# EasyEDA Pro project sle_keyboard.eprj, board PCB1
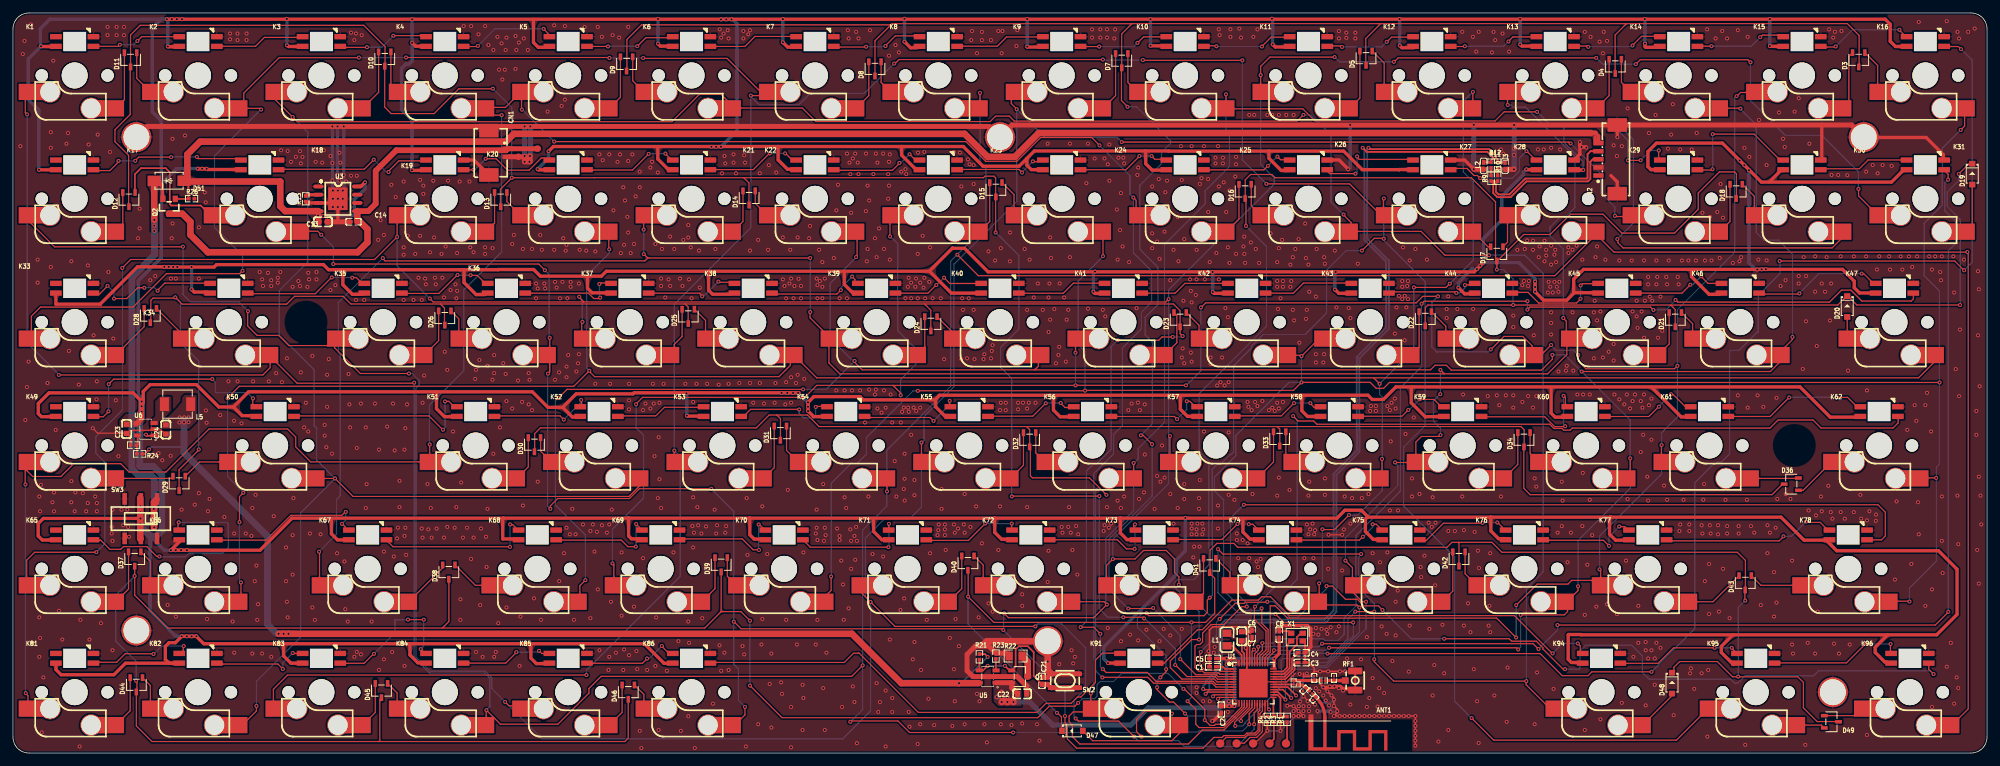
[diagram p2: board, top side]
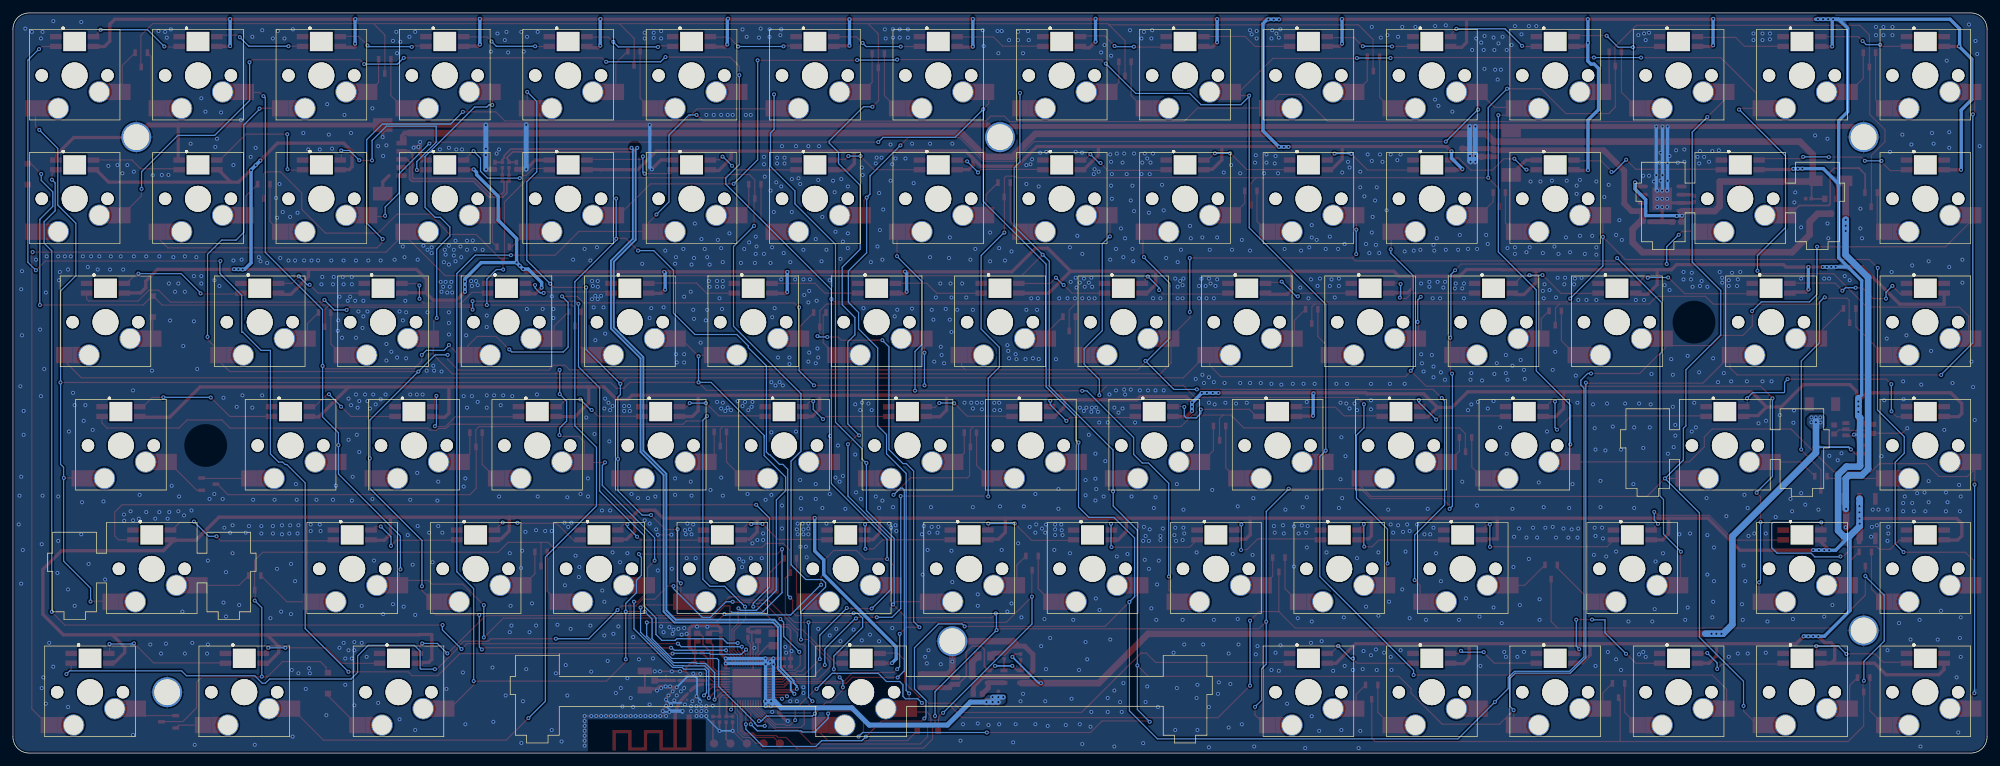
[diagram p3: board, bottom side, seen from below]

Outline 304.8 x 114.3 mm; copper layers: Top Layer, Bottom Layer. Coordinates in mm from the lower left corner of the outline.
Outline path: 0,111.8 0,2.5 0.01,2.3 0.03,2.11 0.07,1.92 0.12,1.73 0.19,1.54 0.27,1.37 0.37,1.19 0.48,1.03 0.6,0.88 0.73,0.73 0.88,0.6 1.03,0.48 1.19,0.37 1.36,0.27 1.54,0.19 1.73,0.12 1.92,0.07 2.11,0.03 2.3,0.01 2.5,0 302.3,0 302.5,0.01 302.69,0.03 302.88,0.07 303.07,0.12 303.26,0.19 303.43,0.27 303.61,0.37 303.77,0.48 303.92,0.6 304.07,0.73 304.2,0.88 304.32,1.03 304.43,1.19 304.53,1.37 304.61,1.54 304.68,1.73 304.73,1.92 304.77,2.11 304.79,2.3 304.8,2.5 304.8,111.8 304.79,112 304.77,112.19 304.73,112.38 304.68,112.57 304.61,112.76 304.53,112.94 304.43,113.11 304.32,113.27 304.2,113.42 304.07,113.57 303.92,113.7 303.77,113.82 303.61,113.93 303.43,114.03 303.26,114.11 303.07,114.18 302.88,114.23 302.69,114.27 302.5,114.29 302.3,114.3 2.5,114.3 2.3,114.29 2.11,114.27 1.92,114.23 1.73,114.18 1.54,114.11 1.36,114.03 1.19,113.93 1.03,113.82 0.88,113.7 0.73,113.57 0.6,113.42 0.48,113.27 0.37,113.11 0.27,112.94 0.19,112.76 0.12,112.57 0.07,112.38 0.03,112.19 0.01,112 0,111.8
Stack: Top Layer 0.035mm / Dielectric1 1.51mm FR4 er 4.5 / Bottom Layer 0.035mm

## Design rules (mm)
net SLE_USB_P: DP1
net SLE_USB_N: DP1
net USB_P: DP2
net USB_N: DP2
template: 自定义配置
spacing copperThickness1oz (default): track to track 0.102, other pairs 0 to 0.3
spacing copperThickness2oz: track to track 0.203, other pairs 0.152 to 0.3
track width copperThickness1oz (default): min 0.127, default 0.254, max 2.54
track width copperThickness2oz: min 0.203, default 0.254, max 2.54
differential pair differentialPair (default): width min 0.127, default 0.254, max 2.54; gap min 0.152, default 0.152
via viaSize (default): diameter min 0.5, default 0.61, max 10; hole min 0.3, default 0.305, max 6.3
['net', 'gnd'] ['NET', 'SLE_3V3'] uses copperThickness1oz

## Placement (name value [footprint] x y rotation side)
ANT1  2.4G板载天线  [ANT-2.4G]  210.69 5.46 180 top
C1  1uF  [C0402]  185.29 13.34 0 top
C2  100nF  [C0402]  186.57 6.73 270 top
C3  2.2uF  [C0402]  198.96 13.97 0 top
C4  1uF  [C0402]  198.96 15.49 0 top
C5  1uF  [C0402]  185.29 14.61 180 top
C6  2.2uF  [C0402]  191.32 18.43 90 top
C7  10uF  [C0603]  189.74 18.03 90 top
C8  4.7uF  [C0402]  195.51 18.29 90 top
C9  NC  [C0201]  200.91 11.61 270 top
C10  NC  [C0201]  203.97 11.61 270 top
C11  NC  [C0201]  200.91 8.38 45 top
C12  NC  [C0201]  199.39 9.78 45 top
C13  10uF  [C0603]  47.88 82.04 0 top
C14  100nF  [C0402]  52.58 82.04 180 top
C21  10nF  [C0402]  158.88 11.16 270 top
C22  10uF  [C0603]  155.83 9.14 0 top
C23  4.7uF  [C0603]  17.56 50.07 90 top
C24  10uF  [C0603]  23.61 49.97 90 top
CN1  1.25-2A-WT  [CONN-TH_1.25-2A-WT]  74.93 92.71 270 top
CN2  1.25-5A-WT  [CONN-SMD_1.25-6A-WT]  246.25 91.69 90 top
D3  BAV70  [SOT-23-3_L3.0-W1.7-P0.95-LS2.9-BR]  284.99 107.06 90 top
D4  BAV70  [SOT-23-3_L3.0-W1.7-P0.95-LS2.9-BR]  247.4 106.05 90 top
D5  BAV70  [SOT-23-3_L3.0-W1.7-P0.95-LS2.9-BR]  208.91 107.32 90 top
D7  BAV70  [SOT-23-3_L3.0-W1.7-P0.95-LS2.9-BR]  171.2 106.93 90 top
D8  BAV70  [SOT-23-3_L3.0-W1.7-P0.95-LS2.9-BR]  133.1 105.66 90 top
D9  BAV70  [SOT-23-3_L3.0-W1.7-P0.95-LS2.9-BR]  94.74 106.43 90 top
D10  BAV70  [SOT-23-3_L3.0-W1.7-P0.95-LS2.9-BR]  57.4 107.19 90 top
D11  BAV70  [SOT-23-3_L3.0-W1.7-P0.95-LS2.9-BR]  18.16 107.06 90 top
D12  BAV70  [SOT-23-3_L3.0-W1.7-P0.95-LS2.9-BR]  17.91 85.47 90 top
D13  BAV70  [SOT-23-3_L3.0-W1.7-P0.95-LS2.9-BR]  75.31 85.47 90 top
D14  BAV70  [SOT-23-3_L3.0-W1.7-P0.95-LS2.9-BR]  113.67 85.73 90 top
D15  BAV70  [SOT-23-3_L3.0-W1.7-P0.95-LS2.9-BR]  151.77 87 90 top
D16  BAV70  [SOT-23-3_L3.0-W1.7-P0.95-LS2.9-BR]  190.25 86.74 90 top
D17  BAV70  [SOT-23-3_L3.0-W1.7-P0.95-LS2.9-BR]  229.11 77.09 90 top
D18  BAV70  [SOT-23-3_L3.0-W1.7-P0.95-LS2.9-BR]  266.06 86.74 90 top
D19  1N4148W  [SOD-123_L2.7-W1.6-LS3.7-FD]  302.51 89.41 90 top
D20  1N4148W  [SOD-123_L2.7-W1.6-LS3.7-FD]  283.21 68.96 90 top
D21  BAV70  [SOT-23-3_L3.0-W1.7-P0.95-LS2.9-BR]  256.67 66.93 90 top
D22  BAV70  [SOT-23-3_L3.0-W1.7-P0.95-LS2.9-BR]  218.06 67.06 90 top
D23  BAV70  [SOT-23-3_L3.0-W1.7-P0.95-LS2.9-BR]  180.21 66.93 90 top
D24  BAV70  [SOT-23-3_L3.0-W1.7-P0.95-LS2.9-BR]  141.73 66.29 90 top
D25  BAV70  [SOT-23-3_L3.0-W1.7-P0.95-LS2.9-BR]  104.27 67.44 90 top
D26  BAV70  [SOT-23-3_L3.0-W1.7-P0.95-LS2.9-BR]  66.68 67.18 90 top
D28  BAV70  [SOT-23-3_L3.0-W1.7-P0.95-LS2.9-BR]  21.21 67.56 90 top
D29  BAV70  [SOT-23-3_L3.0-W1.7-P0.95-LS2.9-BR]  25.65 41.66 90 top
D30  BAV70  [SOT-23-3_L3.0-W1.7-P0.95-LS2.9-BR]  80.52 47.63 90 top
D31  BAV70  [SOT-23-3_L3.0-W1.7-P0.95-LS2.9-BR]  118.49 49.4 90 top
D32  BAV70  [SOT-23-3_L3.0-W1.7-P0.95-LS2.9-BR]  156.97 48.39 90 top
D33  BAV70  [SOT-23-3_L3.0-W1.7-P0.95-LS2.9-BR]  195.58 48.51 90 top
D34  BAV70  [SOT-23-3_L3.0-W1.7-P0.95-LS2.9-BR]  233.3 48.39 90 top
D36  BAV70  [SOT-23-3_L3.0-W1.7-P0.95-LS2.9-BR]  274.57 41.53 0 top
D37  BAV70  [SOT-23-3_L3.0-W1.7-P0.95-LS2.9-BR]  18.8 29.97 90 top
D38  BAV70  [SOT-23-3_L3.0-W1.7-P0.95-LS2.9-BR]  67.3 27.95 90 top
D39  BAV70  [SOT-23-3_L3.0-W1.7-P0.95-LS2.9-BR]  109.35 29.08 90 top
D40  BAV70  [SOT-23-3_L3.0-W1.7-P0.95-LS2.9-BR]  147.45 29.34 90 top
D41  BAV70  [SOT-23-3_L3.0-W1.7-P0.95-LS2.9-BR]  184.77 28.97 90 top
D42  BAV70  [SOT-23-3_L3.0-W1.7-P0.95-LS2.9-BR]  223.27 29.97 90 top
D43  BAV70  [SOT-23-3_L3.0-W1.7-P0.95-LS2.9-BR]  267.46 26.29 90 top
D44  BAV70  [SOT-23-3_L3.0-W1.7-P0.95-LS2.9-BR]  19.05 10.54 90 top
D45  BAV70  [SOT-23-3_L3.0-W1.7-P0.95-LS2.9-BR]  56.9 9.65 90 top
D46  BAV70  [SOT-23-3_L3.0-W1.7-P0.95-LS2.9-BR]  95.01 9.41 90 top
D47  1N4148W  [SOD-123_L2.7-W1.6-LS3.7-FD]  163.58 3.43 180 top
D48  1N4148W  [SOD-123_L2.7-W1.6-LS3.7-FD]  256.16 10.8 90 top
D49  BAV70  [SOT-23-3_L3.0-W1.7-P0.95-LS2.9-BR]  280.77 4.83 180 top
D51  SS54  [SMA_L4.3-W2.6-LS5.0-FD]  24.12 88.38 180 top
K1  DEL  [PCBCOMPONENT_2 - DUPLICATE - DUPLICATE]  9.53 104.65 0 top
K2  F11  [PCBCOMPONENT_2 - DUPLICATE - DUPLICATE]  28.58 104.65 0 top
K3  F11  [PCBCOMPONENT_2 - DUPLICATE - DUPLICATE]  47.63 104.65 0 top
K4  F11  [PCBCOMPONENT_2 - DUPLICATE - DUPLICATE]  66.68 104.65 0 top
K5  F11  [PCBCOMPONENT_2 - DUPLICATE - DUPLICATE]  85.73 104.65 0 top
K6  F11  [PCBCOMPONENT_2 - DUPLICATE - DUPLICATE]  104.78 104.65 0 top
K7  F11  [PCBCOMPONENT_2 - DUPLICATE - DUPLICATE]  123.83 104.65 0 top
K8  F11  [PCBCOMPONENT_2 - DUPLICATE - DUPLICATE]  142.88 104.65 0 top
K9  F11  [PCBCOMPONENT_2 - DUPLICATE - DUPLICATE]  161.93 104.65 0 top
K10  F11  [PCBCOMPONENT_2 - DUPLICATE - DUPLICATE]  180.98 104.65 0 top
K11  F11  [PCBCOMPONENT_2 - DUPLICATE - DUPLICATE]  200.03 104.65 0 top
K12  F11  [PCBCOMPONENT_2 - DUPLICATE - DUPLICATE]  219.08 104.65 0 top
K13  F11  [PCBCOMPONENT_2 - DUPLICATE - DUPLICATE]  238.13 104.65 0 top
K14  F2  [PCBCOMPONENT_2 - DUPLICATE - DUPLICATE]  257.18 104.65 0 top
K15  F1  [PCBCOMPONENT_2 - DUPLICATE - DUPLICATE]  276.23 104.65 0 top
K16  ESC  [PCBCOMPONENT_2 - DUPLICATE - DUPLICATE]  295.28 104.65 0 top
K17  ESC  [PCBCOMPONENT_2 - DUPLICATE - DUPLICATE]  9.53 85.6 0 top
K18  F11  [PCBCOMPONENT_2 - DUPLICATE - DUPLICATE]  38.1 85.6 0 top
K19  F11  [PCBCOMPONENT_2 - DUPLICATE - DUPLICATE]  66.68 85.6 0 top
K20  F11  [PCBCOMPONENT_2 - DUPLICATE - DUPLICATE]  85.73 85.6 0 top
K21  F11  [PCBCOMPONENT_2 - DUPLICATE - DUPLICATE]  104.78 85.6 0 top
K22  F11  [PCBCOMPONENT_2 - DUPLICATE - DUPLICATE]  123.83 85.6 0 top
K23  F11  [PCBCOMPONENT_2 - DUPLICATE - DUPLICATE]  142.88 85.6 0 top
K24  F11  [PCBCOMPONENT_2 - DUPLICATE - DUPLICATE]  161.93 85.6 0 top
K25  F11  [PCBCOMPONENT_2 - DUPLICATE - DUPLICATE]  180.98 85.6 0 top
K26  F11  [PCBCOMPONENT_2 - DUPLICATE - DUPLICATE]  200.03 85.6 0 top
K27  F11  [PCBCOMPONENT_2 - DUPLICATE - DUPLICATE]  219.08 85.6 0 top
K28  F11  [PCBCOMPONENT_2 - DUPLICATE - DUPLICATE]  238.13 85.6 0 top
K29  F11  [PCBCOMPONENT_2 - DUPLICATE - DUPLICATE]  257.18 85.6 0 top
K30  F11  [PCBCOMPONENT_2 - DUPLICATE - DUPLICATE]  276.23 85.6 0 top
K31  F11  [PCBCOMPONENT_2 - DUPLICATE - DUPLICATE]  295.28 85.6 0 top
K33  ESC  [PCBCOMPONENT_2 - DUPLICATE - DUPLICATE]  9.53 66.55 0 top
K34  F11  [PCBCOMPONENT_2 - DUPLICATE - DUPLICATE]  33.34 66.55 0 top
K35  F11  [PCBCOMPONENT_2 - DUPLICATE - DUPLICATE]  57.15 66.55 0 top
K36  F11  [PCBCOMPONENT_2 - DUPLICATE - DUPLICATE]  76.2 66.55 0 top
K37  F11  [PCBCOMPONENT_2 - DUPLICATE - DUPLICATE]  95.25 66.55 0 top
K38  F11  [PCBCOMPONENT_2 - DUPLICATE - DUPLICATE]  114.3 66.55 0 top
K39  F11  [PCBCOMPONENT_2 - DUPLICATE - DUPLICATE]  133.35 66.55 0 top
K40  F11  [PCBCOMPONENT_2 - DUPLICATE - DUPLICATE]  152.4 66.55 0 top
K41  F11  [PCBCOMPONENT_2 - DUPLICATE - DUPLICATE]  171.45 66.55 0 top
K42  F11  [PCBCOMPONENT_2 - DUPLICATE - DUPLICATE]  190.5 66.55 0 top
K43  F11  [PCBCOMPONENT_2 - DUPLICATE - DUPLICATE]  209.55 66.55 0 top
K44  F11  [PCBCOMPONENT_2 - DUPLICATE - DUPLICATE]  228.6 66.55 0 top
K45  F11  [PCBCOMPONENT_2 - DUPLICATE - DUPLICATE]  247.65 66.55 0 top
K46  F11  [PCBCOMPONENT_2 - DUPLICATE - DUPLICATE]  266.7 66.55 0 top
K47  F11  [PCBCOMPONENT_2 - DUPLICATE - DUPLICATE]  290.51 66.55 0 top
K49  ESC  [PCBCOMPONENT_2 - DUPLICATE - DUPLICATE]  9.53 47.5 0 top
K50  F11  [PCBCOMPONENT_2 - DUPLICATE - DUPLICATE]  40.48 47.5 0 top
K51  F11  [PCBCOMPONENT_2 - DUPLICATE - DUPLICATE]  71.44 47.5 0 top
K52  F11  [PCBCOMPONENT_2 - DUPLICATE - DUPLICATE]  90.49 47.5 0 top
K53  F11  [PCBCOMPONENT_2 - DUPLICATE - DUPLICATE]  109.54 47.5 0 top
K54  F11  [PCBCOMPONENT_2 - DUPLICATE - DUPLICATE]  128.59 47.5 0 top
K55  F11  [PCBCOMPONENT_2 - DUPLICATE - DUPLICATE]  147.64 47.5 0 top
K56  F11  [PCBCOMPONENT_2 - DUPLICATE - DUPLICATE]  166.69 47.5 0 top
K57  F11  [PCBCOMPONENT_2 - DUPLICATE - DUPLICATE]  185.74 47.5 0 top
K58  F11  [PCBCOMPONENT_2 - DUPLICATE - DUPLICATE]  204.79 47.5 0 top
K59  F11  [PCBCOMPONENT_2 - DUPLICATE - DUPLICATE]  223.84 47.5 0 top
K60  F11  [PCBCOMPONENT_2 - DUPLICATE - DUPLICATE]  242.89 47.5 0 top
K61  F11  [PCBCOMPONENT_2 - DUPLICATE - DUPLICATE]  261.94 47.5 0 top
K62  F11  [PCBCOMPONENT_2 - DUPLICATE - DUPLICATE]  288.13 47.5 0 top
K65  ESC  [PCBCOMPONENT_2 - DUPLICATE - DUPLICATE]  9.53 28.45 0 top
K66  F11  [PCBCOMPONENT_2 - DUPLICATE - DUPLICATE]  28.58 28.45 0 top
K67  F11  [PCBCOMPONENT_2 - DUPLICATE - DUPLICATE]  54.77 28.45 0 top
K68  F11  [PCBCOMPONENT_2 - DUPLICATE - DUPLICATE]  80.97 28.45 0 top
K69  F11  [PCBCOMPONENT_2 - DUPLICATE - DUPLICATE]  100.02 28.45 0 top
K70  F11  [PCBCOMPONENT_2 - DUPLICATE - DUPLICATE]  119.07 28.45 0 top
K71  F11  [PCBCOMPONENT_2 - DUPLICATE - DUPLICATE]  138.12 28.45 0 top
K72  F11  [PCBCOMPONENT_2 - DUPLICATE - DUPLICATE]  157.17 28.45 0 top
K73  F11  [PCBCOMPONENT_2 - DUPLICATE - DUPLICATE]  176.22 28.45 0 top
K74  F11  [PCBCOMPONENT_2 - DUPLICATE - DUPLICATE]  195.27 28.45 0 top
K75  F11  [PCBCOMPONENT_2 - DUPLICATE - DUPLICATE]  214.32 28.45 0 top
K76  F11  [PCBCOMPONENT_2 - DUPLICATE - DUPLICATE]  233.37 28.45 0 top
K77  F11  [PCBCOMPONENT_2 - DUPLICATE - DUPLICATE]  252.42 28.45 0 top
K78  F11  [PCBCOMPONENT_2 - DUPLICATE - DUPLICATE]  283.37 28.45 0 top
K81  ESC  [PCBCOMPONENT_2 - DUPLICATE - DUPLICATE]  9.53 9.4 0 top
K82  F11  [PCBCOMPONENT_2 - DUPLICATE - DUPLICATE]  28.58 9.4 0 top
K83  F11  [PCBCOMPONENT_2 - DUPLICATE - DUPLICATE]  47.63 9.4 0 top
K84  F11  [PCBCOMPONENT_2 - DUPLICATE - DUPLICATE]  66.68 9.4 0 top
K85  F11  [PCBCOMPONENT_2 - DUPLICATE - DUPLICATE]  85.73 9.4 0 top
K86  F11  [PCBCOMPONENT_2 - DUPLICATE - DUPLICATE]  104.78 9.4 0 top
K91  F11  [PCBCOMPONENT_2 - DUPLICATE - DUPLICATE]  173.84 9.4 0 top
K94  F11  [PCBCOMPONENT_2 - DUPLICATE - DUPLICATE]  245.27 9.4 0 top
K95  F11  [PCBCOMPONENT_2 - DUPLICATE - DUPLICATE]  269.08 9.4 0 top
K96  F11  [PCBCOMPONENT_2 - DUPLICATE - DUPLICATE]  292.9 9.4 0 top
L1  10uH  [L0805]  187.45 17.54 90 top
L2  10uH  [L0402]  227.08 90.69 270 top
L3  10uH  [L0402]  230.38 90.69 90 top
L5  2.2uH  [IND-SMD_L4.4-W4.2]  25.41 53.88 180 top
NOREF  -  [Pad_e235]  186.39 1.48 0 top
NOREF#2  -  [Pad_e136]  152.4 95.12 0 top
NOREF#3  -  [Pad_e232]  194.01 1.48 0 top
NOREF#4  -  [Pad_e3429]  78.04 92.09 0 top
NOREF#5  -  [Pad_e135]  285.75 95.12 0 top
NOREF#6  -  [Pad_e939]  152.65 9.53 0 top
NOREF#7  -  [Pad_e139]  19.05 18.92 0 top
NOREF#8  -  [Pad_e228]  196.55 1.48 0 top
NOREF#9  -  [Pad_e234]  188.93 1.48 0 top
NOREF#10  -  [Pad_e133]  280.99 9.4 0 top
NOREF#11  -  [Pad_e137]  159.77 17.27 0 top
NOREF#12  -  [Pad_e233]  191.47 1.48 0 top
NOREF#13  -  [Pad_e3392]  81.03 93.35 0 top
NOREF#14  -  [Pad_e138]  19.05 95.12 0 top
Q1  CJ3401  [SOT-23-3_L2.9-W1.6-P1.90-LS2.8-BR]  155.45 11.81 180 top
Q2  AO3401A  [SOT-23_L2.9-W1.3-P1.90-LS2.4-BR]  24.11 84.44 90 top
R1  100R  [R0402]  196.72 5.21 270 top
R2  100R  [R0402]  194.69 5.21 270 top
R3  100K  [R0402]  195.71 5.21 90 top
R4  100K  [R0402]  193.68 5.21 270 top
R5  0  [R0201]  197.74 10.84 90 top
R6  0  [R0201#2]  198.12 10.59 180 top
R7  50R  [R0201]  202.34 11.2 0 top
R8  50R  [R0201]  200.41 9.4 135 top
R9  10K  [R0402]  228.22 88.77 90 top
R10  10K  [R0402]  229.24 88.77 90 top
R11  10K  [R0402]  228.22 90.81 90 top
R12  10K  [R0402]  229.24 90.81 90 top
R13  4K  [R0402]  45.21 85.6 90 top
R21  1K  [R0402]  149.22 14.86 90 top
R22  22R  [R0805]  154.81 14.99 0 top
R23  5.1K  [R0402]  151.77 14.99 270 top
R24  90.9K  [R0402]  19.56 46.2 180 top
R25  20K  [R0402]  18.63 47.55 180 top
R26  1M  [R0402]  27.58 85.62 0 top
RF1  BWIPX-1-001E  [IPEX-SMD_BWIPX-1-001E]  206.48 11.2 0 top
SW2  SKRPABE010  [KEY-SMD_4P-L4.2-W3.2-P2.20-LS4.6]  162.43 11.16 180 top
SW3  SS-3235S-L1  [SW-SMD_SS-3235S-LX]  19.75 36.2 0 top
U1  -  [QFN-48_L6.0-W6.0-P0.40-TL-EP4.4]  191.52 10.8 0 top
U3  TP4056X-42-ESOP8  [SOP-8_L4.9-W3.9-P1.27-LS6.0-TL-EP]  50.16 85.6 0 top
U5  MT9700  [SOT-23-5_L3.0-W1.7-P0.95-LS2.8-BR]  150.5 11.81 0 top
U6  TLV62569DBVR  [SOT-23-5_L3.0-W1.7-P0.95-LS2.8-BR]  20.5 50.02 0 top
X1  32MHz  [OSC-SMD_4P-L2.0-W1.6-BL]  198.24 17.9 180 top

## Footprints (pads in the part's own frame, mm; a bottom-side part is the same pattern mirrored in y, then rotated)
ANT-2.4G
  rect 0.508x0.508 smd: 1(8.128,0)
  rect 0.762x0.762 smd: 2(10.287,-0.127)
C0201
  rect 0.368x0.324 smd: 1(-0.275,0) 2(0.275,0)
C0402
  rect 0.79x0.54 smd: 1(-0.545,0) 2(0.545,0)
C0603
  rect 0.8x0.9 smd: 1(-0.7,0) 2(0.7,0)
CONN-SMD_1.25-6A-WT
  rect 0.7x1.6 smd: 1(-2.5,1.45) 2(-1.25,1.45) 3(0,1.45) 4(1.25,1.45) 5(2.5,1.45)
  rect 2.1x3 smd: 6(5.3,-1.45) 7(-5.3,-1.45)
CONN-TH_1.25-2A-WT
  rect 0.7x1.6 smd: 1(-0.625,1.45) 2(0.625,1.45)
  rect 2.1x3 smd: 3(3.425,-1.45) 4(-3.425,-1.45)
IND-SMD_L4.4-W4.2
  rect 1.4x2.12 smd: 1(2.028,0) 2(-2.028,0)
IPEX-SMD_BWIPX-1-001E
  rect 1.05x1 smd: 1(-0.762,0)
  rect 2.2x1.05 smd: 2(0.762,-1.475) 3(0.762,1.475)
KEY-SMD_4P-L4.2-W3.2-P2.20-LS4.6
  rect 1.05x0.7 smd: 1(-2.1,1.075) 2(2.1,1.075) 3(-2.1,-1.075) 4(2.1,-1.075)
L0402
  rect 0.79x0.54 smd: 1(-0.545,0) 2(0.545,0)
L0805
  rect 1.133x1.377 smd: 1(-0.966,0) 2(0.966,0)
OSC-SMD_4P-L2.0-W1.6-BL
  rect 1x0.8 smd: 1(-0.9,-0.6) 2(0.9,-0.6) 3(0.9,0.6) 4(-0.9,0.6)
Pad_e133
  round 4.61 hole 4: 1(0,0)
Pad_e135
  round 4.61 hole 4: 1(0,0)
Pad_e136
  round 4.61 hole 4: 1(0,0)
Pad_e137
  round 4.61 hole 4: 1(0,0)
Pad_e138
  round 4.61 hole 4: 1(0,0)
Pad_e139
  round 4.61 hole 4: 1(0,0)
Pad_e228
  round 1.27 smd: TP1(0,0)
Pad_e232
  round 1.27 smd: TP2(0,0)
Pad_e233
  round 1.27 smd: TP3(0,0)
Pad_e234
  round 1.27 smd: TP4(0,0)
Pad_e235
  round 1.27 smd: TP5(0,0)
Pad_e939
  round 0.61 smd: TP1(0,0)
Pad_e3392
  round 1.016 smd: TP1(0,0)
Pad_e3429
  round 1.016 smd: TP3(0,0)
PCBCOMPONENT_2 - DUPLICATE - DUPLICATE
  rect 2.55x2.5 smd: 1(6.35,-5.081) 2(-7.366,-2.541)
  round 3.302 hole 3.005x3: 3(2.54,-5.081) 4(-3.81,-2.541)
  round 1.905 hole 1.91x1.905: 5(5.08,-0.001) 6(-5.08,-0.001)
  round 4 hole 4.005x4: 7(0,-0.001)
  rect 1.8x0.82 smd: 8(-2.9,4.489) 9(-2.9,5.989) 10(2.9,5.989) 11(2.9,4.489)
QFN-48_L6.0-W6.0-P0.40-TL-EP4.4
  rect 1x0.2 smd: 1(-3.1,2.2) 2(-3.1,1.8) 3(-3.1,1.4) 4(-3.1,1) 5(-3.1,0.6) 6(-3.1,0.2) 7(-3.1,-0.2) 8(-3.1,-0.6) 9(-3.1,-1) 10(-3.1,-1.4) 11(-3.1,-1.8) 12(-3.1,-2.2) 25(3.1,-2.2) 26(3.1,-1.8) 27(3.1,-1.4) 28(3.1,-1) 29(3.1,-0.6) 30(3.1,-0.2) 31(3.1,0.2) 32(3.1,0.6) 33(3.1,1) 34(3.1,1.4) 35(3.1,1.8) 36(3.1,2.2)
  rect 0.2x1 smd: 13(-2.2,-3.1) 14(-1.8,-3.1) 15(-1.4,-3.1) 16(-1,-3.1) 17(-0.6,-3.1) 18(-0.2,-3.1) 19(0.2,-3.1) 20(0.6,-3.1) 21(1,-3.1) 22(1.4,-3.1) 23(1.8,-3.1) 24(2.2,-3.1) 37(2.2,3.1) 38(1.8,3.1) 39(1.4,3.1) 40(1,3.1) 41(0.6,3.1) 42(0.2,3.1) 43(-0.2,3.1) 44(-0.6,3.1) 45(-1,3.1) 46(-1.4,3.1) 47(-1.8,3.1) 48(-2.2,3.1)
  rect 4.4x4.4 smd: 49(0,0)
R0201
  rect 0.303x0.324 smd: 1(-0.241,0) 2(0.241,0)
R0201#2
  rect 0.303x0.324 smd: 1(-0.241,0)
R0402
  rect 0.566x0.54 smd: 1(-0.433,0) 2(0.433,0)
R0805
  rect 1.133x1.377 smd: 1(-1,0) 2(1,0)
SMA_L4.3-W2.6-LS5.0-FD
  rect 2.046x1.62 smd: 1(-2.304,-0.009) 2(2.304,0.009)
SOD-123_L2.7-W1.6-LS3.7-FD
  rect 0.88x0.96 smd: 1(-1.61,0) 2(1.61,0)
SOP-8_L4.9-W3.9-P1.27-LS6.0-TL-EP
  oval 1.6x0.6 smd: 1(-3,1.905) 2(-3,0.635) 3(-3,-0.635) 4(-3,-1.905) 5(3,-1.905) 6(3,-0.635) 7(3,0.635) 8(3,1.905)
  rect 3x3.5 smd: 9(0,0)
SOT-23-3_L2.9-W1.6-P1.90-LS2.8-BR
  rect 1.07x0.6 smd: 1(1.235,-0.95) 2(1.235,0.95) 3(-1.235,0)
SOT-23-3_L3.0-W1.7-P0.95-LS2.9-BR
  rect 1.038x0.532 smd: 1(1.101,-0.95) 2(1.101,0.95) 3(-1.101,0)
SOT-23-5_L3.0-W1.7-P0.95-LS2.8-BR
  rect 1.1x0.6 smd: 1(1.3,-0.95) 2(1.3,0) 3(1.3,0.95) 4(-1.3,0.95) 5(-1.3,-0.95)
SOT-23_L2.9-W1.3-P1.90-LS2.4-BR
  rect 1x0.8 smd: 1(1.15,-0.95) 2(1.15,0.95) 3(-1.15,0)
SW-SMD_SS-3235S-LX
  rect 0.7x1.8 smd: 1(-2.5,3.05) 2(0,3.05) 3(2.5,3.05) 4(-2.5,-3.05) 5(0,-3.05) 6(2.5,-3.05)

## Nets
As in the schematic, except:
GND: ANT1.2 C1.1 C2.2 C3.2 C4.2 C5.2 C6.2 C7.2 C8.2 C9.1 C10.1 C11.1 C12.1 C13.2 C14.2 C21.1 C22.2 C23.1 C24.1 CN1.2 CN1.3 CN1.4 CN2.2 CN2.6 CN2.7 K1.10 K2.10 K3.10 K4.10 K5.10 K6.10 K7.10 K8.10 K9.10 K10.10 K11.10 K12.10 K13.10 K14.10 K15.10 K16.10 K17.10 K18.10 K19.10 K20.10 K21.10 K22.10 K23.10 K24.10 K25.10 K26.10 K27.10 K28.10 K29.10 K30.10 K31.10 K33.10 K34.10 K35.10 K36.10 K37.10 K38.10 K39.10 K40.10 K41.10 K42.10 K43.10 K44.10 K45.10 K46.10 K47.10 K49.10 K50.10 K51.10 K52.10 K53.10 K54.10 K55.10 K56.10 K57.10 K58.10 K59.10 K60.10 K61.10 K62.10 K65.10 K66.10 K67.10 K68.10 K69.10 K70.10 K71.10 K72.10 K73.10 K74.10 K75.10 K76.10 K77.10 K78.10 K81.10 K82.10 K83.10 K84.10 K85.10 K86.10 K91.10 K94.10 K95.10 K96.10 L2.2 L3.1 NOREF#2.1 NOREF#4.TP3 NOREF#5.1 NOREF#7.1 NOREF#10.1 NOREF#11.1 NOREF#12.TP3 NOREF#14.1 R3.1 R4.2 R13.1 R22.1 R23.1 R25.2 R26.2 RF1.2 RF1.3 SW2.3 SW2.4 SW3.1 SW3.4 U1.31 U1.45 U1.49 U3.1 U3.3 U3.6 U3.7 U3.9 U5.2 U6.2 X1.2 X1.4
VBAT: C14.1 CN1.1 NOREF#13.TP1 Q2.3 U3.5
RF: R5.1 U1.30
SLE_3V3: C2.1 C5.1 C8.1 C22.1 NOREF#6.TP1 Q1.2 U1.13 U1.36 U1.48 U5.1
SLE_DBG_RX: NOREF#9.TP4 U1.23
SLE_DBG_TX: NOREF.TP5 U1.22
SWD_CLK: NOREF#3.TP2 R2.2
SWD_DAT: NOREF#8.TP1 R1.2

Pads without a net: CN2 1; K1 3 4 5 6 7 9; K2 3 4 5 6 7; K3 3 4 5 6 7; K4 3 4 5 6 7; K5 3 4 5 6 7; K6 3 4 5 6 7; K7 3 4 5 6 7; K8 3 4 5 6 7; K9 3 4 5 6 7; K10 3 4 5 6 7; K11 3 4 5 6 7; K12 3 4 5 6 7; K13 3 4 5 6 7; K14 3 4 5 6 7; K15 3 4 5 6 7; K16 3 4 5 6 7; K17 3 4 5 6 7 9; K18 3 4 5 6 7; K19 3 4 5 6 7; K20 3 4 5 6 7; K21 3 4 5 6 7; K22 3 4 5 6 7; K23 3 4 5 6 7; K24 3 4 5 6 7; K25 3 4 5 6 7; K26 3 4 5 6 7; K27 3 4 5 6 7; K28 3 4 5 6 7; K29 3 4 5 6 7; K30 3 4 5 6 7; K31 3 4 5 6 7; K33 3 4 5 6 7 9; K34 3 4 5 6 7; K35 3 4 5 6 7; K36 3 4 5 6 7; K37 3 4 5 6 7; K38 3 4 5 6 7; K39 3 4 5 6 7; K40 3 4 5 6 7; K41 3 4 5 6 7; K42 3 4 5 6 7; K43 3 4 5 6 7; K44 3 4 5 6 7; K45 3 4 5 6 7; K46 3 4 5 6 7; K47 3 4 5 6 7; K49 3 4 5 6 7 9; K50 3 4 5 6 7; K51 3 4 5 6 7; K52 3 4 5 6 7; K53 3 4 5 6 7; K54 3 4 5 6 7; K55 3 4 5 6 7; K56 3 4 5 6 7; K57 3 4 5 6 7; K58 3 4 5 6 7; K59 3 4 5 6 7; K60 3 4 5 6 7; K61 3 4 5 6 7; K62 3 4 5 6 7; K65 3 4 5 6 7 9; K66 3 4 5 6 7; K67 3 4 5 6 7; K68 3 4 5 6 7; K69 3 4 5 6 7; K70 3 4 5 6 7; K71 3 4 5 6 7; K72 3 4 5 6 7; K73 3 4 5 6 7; K74 3 4 5 6 7; K75 3 4 5 6 7; K76 3 4 5 6 7; K77 3 4 5 6 7; K78 3 4 5 6 7; K81 3 4 5 6 7 9; K82 3 4 5 6 7; K83 3 4 5 6 7; K84 3 4 5 6 7; K85 3 4 5 6 7; K86 3 4 5 6 7; K91 3 4 5 6 7; K94 3 4 5 6 7; K95 3 4 5 6 7; K96 3 4 5 6 7; SW3 6

## Via types
v1: diameter 0.61, hole 0.33, Top Layer to Bottom Layer, 2284 vias
v2: diameter 0.61, hole 0.305, Top Layer to Bottom Layer, 32 vias

## Routing (per net, layer and track width the routed paths; a pad name or vN(x,y) marks a point on that pad's centre or on a via; arc(x,y) is an arc through that point)
5V_STD: length 2211.1
  Top Layer w0.254: 20.61,49.09 20.7,49 21.58,49
  Top Layer w0.508: v1(19.88,54.3) 18.55,55.63 5.56,55.63 3.91,53.97 3.91,52.43 4.39,51.95 6.33,51.95 ; 113.77,36.27 113.77,36.31 ; 113.77,36.27 113.77,33.71 114.44,33.04 115.94,33.04 ; 113.77,36.27 151.58,36.27 ; 113.77,36.27 95.05,36.27 ; 61.66,109.66 62.16,109.16 63.7,109.16 ; 6.64,13.71 6.64,12.89 7.43,12.1 15.59,12.1 17.37,13.87 24.09,13.87 ; 61.3,16.88 79.96,16.88 ; 61.3,16.88 41.78,16.88 ; 61.3,16.88 61.3,15.16 62.52,13.94 63.8,13.94 ; 79.96,16.88 79.96,14.66 80.81,13.81 82.56,13.81 82.72,13.97 ; 79.96,16.88 97.5,16.88 100.52,13.85 102.09,13.85 ; 177.58,108.98 177.35,109.22 175.63,109.22 ; 174.89,92.99 174.89,93.03 ; 174.89,92.99 178.41,92.99 178.43,92.97 193.91,92.97 ; 174.89,92.99 174.89,91.02 175.9,90.02 177.97,90.02 ; 174.89,92.99 157.71,92.99 156.56,91.84 ; 125.64,51.96 123.63,51.96 v1(122.77,52.82) 122.77,54.16 123.66,55.05 130.79,55.05 131.29,54.55 142.33,54.55 143.05,55.26 209.22,55.26 209.87,54.6 211.59,54.6 213.53,56.54 216.07,56.54 ; 151.58,36.27 151.58,34.09 152.65,33.02 153.88,33.02 ; 151.58,36.27 170.99,36.27 ; 151.58,36.27 151.58,36.29 ; 75.73,36.27 95.05,36.27 ; 75.73,36.27 43.09,36.27 38.14,31.32 26.84,31.32 ; 75.73,36.27 75.62,36.16 75.62,33.06 77.73,33.06 77.92,32.88 ; 75.73,36.27 75.75,36.29 ; 95.05,36.27 95.05,33.53 95.49,33.09 96.93,33.09 ; 95.05,36.27 95.05,36.31 95.01,36.35 ; 37.28,52 37.17,52.11 35.37,52.11 34.04,53.45 ; 84.88,53.39 82.6,53.39 80.19,55.79 65.39,55.79 ; 84.88,53.39 86.96,55.47 95.74,55.47 95.9,55.64 121.39,55.64 ; 84.88,53.39 86.35,51.91 87.18,51.91 ; 196.98,109.05 194.91,109.05 194.52,109.44 ; 110.82,70.86 108.03,70.86 107.4,71.49 107.4,74.4 ; 91.56,71.07 89.43,71.07 88.7,71.8 88.7,73.63 ; 168.26,70.98 167.06,70.98 166.81,71.23 ; 241.08,71.11 240.97,71 ; 240.97,71 239.92,69.95 236.31,69.95 v1(235.01,71.25) v1(235.01,72.82) ; 240.97,71 240.97,73.18 242.49,74.7 282.48,74.7 284.3,72.88 284.3,71.87 285.11,71.06 287.56,71.06 ; 272.98,109.14 271.34,109.14 271.27,109.21 ; 185.29,71.14 185.43,71 187.43,71 ; 193.91,92.97 205.46,92.97 208.33,90.1 214.04,90.1 ; 193.91,92.97 193.91,91.88 195.81,89.98 196.96,89.98 ; 6.16,109.12 4.37,109.12 v1(4.33,109.15) ; 101.28,90.02 99.56,91.74 99.56,93.59 ; 216.32,108.92 214.47,108.92 214.12,109.27 ; 289.46,18.26 265.56,18.26 ; 289.46,18.26 287.53,16.33 287.53,15.54 288.99,14.08 289.27,14.08 ; 289.46,18.26 297.02,18.26 300.17,21.41 300.17,28.38 297.3,31.25 281.58,31.25 280.03,32.8 ; 265.56,18.26 263.77,16.47 263.77,15.54 265.65,13.66 ; 265.56,18.26 242.15,18.26 242.11,18.31 240.18,18.31 240.13,18.26 240.13,14.47 240.62,13.98 242.03,13.98 242.31,13.7 ; 249.52,32.87 247.45,32.87 246.51,33.81 246.51,36.35 246.6,36.43 ; 223.23,71.83 224.14,70.92 225.85,70.92 ; 128.36,74.37 128.36,72.37 129.86,70.87 ; 120.75,90.16 119.59,90.16 118.15,91.61 118.15,93.67 ; 233.61,90.13 233.73,90.13 233.77,90.09 234.96,90.09 ; 170.99,36.27 204.42,36.27 205.66,37.51 208.19,37.51 209.27,36.43 228.18,36.43 ; 170.99,36.27 170.99,36.31 ; 170.99,36.27 170.99,33.98 172.01,32.96 172.81,32.96 ; 139.47,90.08 137.21,92.34 137.21,93.67 ; 163.08,51.93 161.68,51.93 160.65,52.96 160.65,55.14 ; 118.14,93.67 83.44,93.67 82.67,92.9 ; 118.14,93.67 118.13,93.66 ; 118.14,93.67 118.15,93.67 ; 182.82,52 181.34,52 180.24,53.1 180.24,55.17 ; 26.84,31.32 v1(24.38,31.32) 25.72,32.66 25.72,32.95 ; 26.84,31.32 v1(26.86,31.34) ; 211.12,33 210.03,33 208.82,34.22 208.82,36.14 209.15,36.47 ; 6.51,32.9 4.54,32.9 3.9,33.54 3.9,35.45 4.68,36.23 v1(19.69,36.23) ; 34.04,53.45 36.38,55.79 65.39,55.79 ; 34.04,53.45 31.78,53.45 28.33,56.9 21.17,56.9 20.11,55.84 20.11,54.08 ; 199,55.24 199,52.86 199.88,51.98 201.76,51.98 ; 259.17,74.69 259.17,73.56 261.89,70.84 263.53,70.84 ; 24.09,13.87 25.88,13.87 ; 24.09,13.87 23.53,14.44 23.53,16.48 24.09,17.04 25.07,17.04 v1(26.06,18.03) v1(26.85,18.03) 28.31,18.03 v1(28.32,18.03) 29.47,16.88 41.78,16.88 ; 24.09,13.87 25.63,13.87 ; 99.63,109.5 99.96,109.17 101.89,109.17 ; 118.89,109.74 119.61,109.02 120.39,109.02 ; 149.36,71.03 144.89,71.03 141.52,74.4 ; 69.03,74.64 69.02,74.63 ; 69.03,74.64 48.72,74.64 47.94,75.43 31.42,75.43 31.06,75.06 v1(25.37,75.06) v1(24.74,75.06) 23.41,75.06 v1(23.38,75.09) 19.24,75.09 13.51,69.37 13.51,69.32 6.65,69.32 6.63,69.35 6.63,70.91 6.5,71.04 ; 69.03,74.64 69.64,74.64 ; v1(23.76,113.33) 289.07,113.33 289.85,112.55 289.85,109.93 290.66,109.12 292.32,109.12 292.4,109.2 ; 137.64,109.87 138.59,108.92 139.59,108.92 ; 105.84,52.04 104.17,52.04 104.15,52.06 ; v1(28.51,90.26) 28.53,90.23 v1(29.9,90.23) 30.01,90.12 34.79,90.12 ; 41.78,16.88 41.78,15 42.91,13.87 44.98,13.87 ; 137.21,93.67 118.15,93.67 ; 137.21,93.67 146.72,93.67 149.76,90.63 155.35,90.63 156.56,91.84 ; 137.21,93.67 137.21,93.68 ; 156.58,109.11 156.65,109.04 158.51,109.04 ; 63.2,90.2 62.98,89.98 61.7,89.98 ; 252.95,56.54 257.58,51.91 259.08,51.91 ; 252.95,56.54 216.07,56.54 ; 252.95,56.54 275.93,56.54 280.59,51.88 285.5,51.88 285.51,51.89 ; 170.95,13.82 170.88,13.89 v1(169.07,13.89) ; 156.56,91.84 156.56,90.77 157.23,90.1 158.8,90.1 ; 53.97,70.84 52.42,70.84 50.93,72.33 50.93,74.63 ; 237.49,56.41 237.49,52.5 238.12,51.87 239.83,51.87 ; 291.99,90.12 290.04,88.18 269.97,88.18 263.94,94.2 253.75,94.2 252.44,92.89 252.44,90.56 252.9,90.11 254.41,90.11 ; 69.64,74.64 69.64,72.67 71.51,70.8 72.87,70.8 ; 69.64,74.64 74.89,74.64 74.92,74.68 80.4,74.68 81.43,73.65 90.85,73.65 91.62,74.41 141.48,74.41 145.06,77.99 145.09,77.96 146.93,77.96 150.57,74.32 225.63,74.32 227.05,75.74 ; 228.18,36.43 246.6,36.43 ; 228.18,36.43 228.18,34.3 229.37,33.11 230.9,33.11 ; 228.18,36.43 228.18,36.45 ; 215.82,90.12 214.06,90.12 214.04,90.1 ; 27.61,71.6 27.59,71.6 27.59,71.59 27.98,71.2 29.94,71.2 ; 214.04,90.1 214.02,90.08 ; 234.71,109.19 232.97,109.19 232.8,109.36 ; 135.29,32.94 134.16,32.94 132.88,34.22 132.88,36.24 ; 23.89,109.16 23.97,109.08 25.25,109.08 ; v1(4.02,90.08) 4.02,90.07 5.91,90.07 ; 65.39,55.79 65.39,53.18 66.62,51.95 68.14,51.95 68.18,51.99 ; 206.33,70.99 204.72,70.99 204.19,71.52 ; 44.46,109.12 42.54,109.12 42.38,109.28 ; 246.6,36.43 246.67,36.5 ; 246.6,36.43 272.98,36.43 276.53,32.88 280.57,32.88 280.61,32.92 ; 82.66,90.08 81.11,90.08 v1(81.01,90.18) ; 192.13,33.04 191,33.04 189.91,34.13 189.91,36.12 190.02,36.22 ; 80.32,113.3 80.36,113.26 80.36,109.74 81.12,108.99 82.5,108.99 ; 216.07,56.54 215.9,56.37 215.9,54.09 218.09,51.9 218.14,51.96 220.64,51.96 ; 273.24,90.25 271.17,88.18 ; 244.48,71.1 241.08,71.1 ; 253.8,108.99 252.11,108.99 251.97,109.13 251.97,109.55 252,109.58 ; 52.16,32.92 50.11,32.92 49.17,33.86 49.17,36.2 ; 144.02,51.9 142.46,53.46 142.46,54.59
  Top Layer w0.762: 19.83,54.5 19.83,51.66 18.97,50.79
  Top Layer w1.016: 19.69,33.08 19.65,33.12 19.65,39.42
  Bottom Layer w0.254: v1(20.55,49.17) 20.08,49.17 19.95,49.3 ; 19.88,44.13 21.49,44.13 21.58,44.23